# EasyEDA Pro project Jarvis.eprj, schematic Schematic7_1
Board Name: LogicUnit; Create Date: 2026-04-14; Page Name: P1; Project Name: Jarvis; Schematic Name: Schematic7_1; Update Date: 2026-04-14; Company: EasyEDA.com; Page Size: A4; Version: V1.0
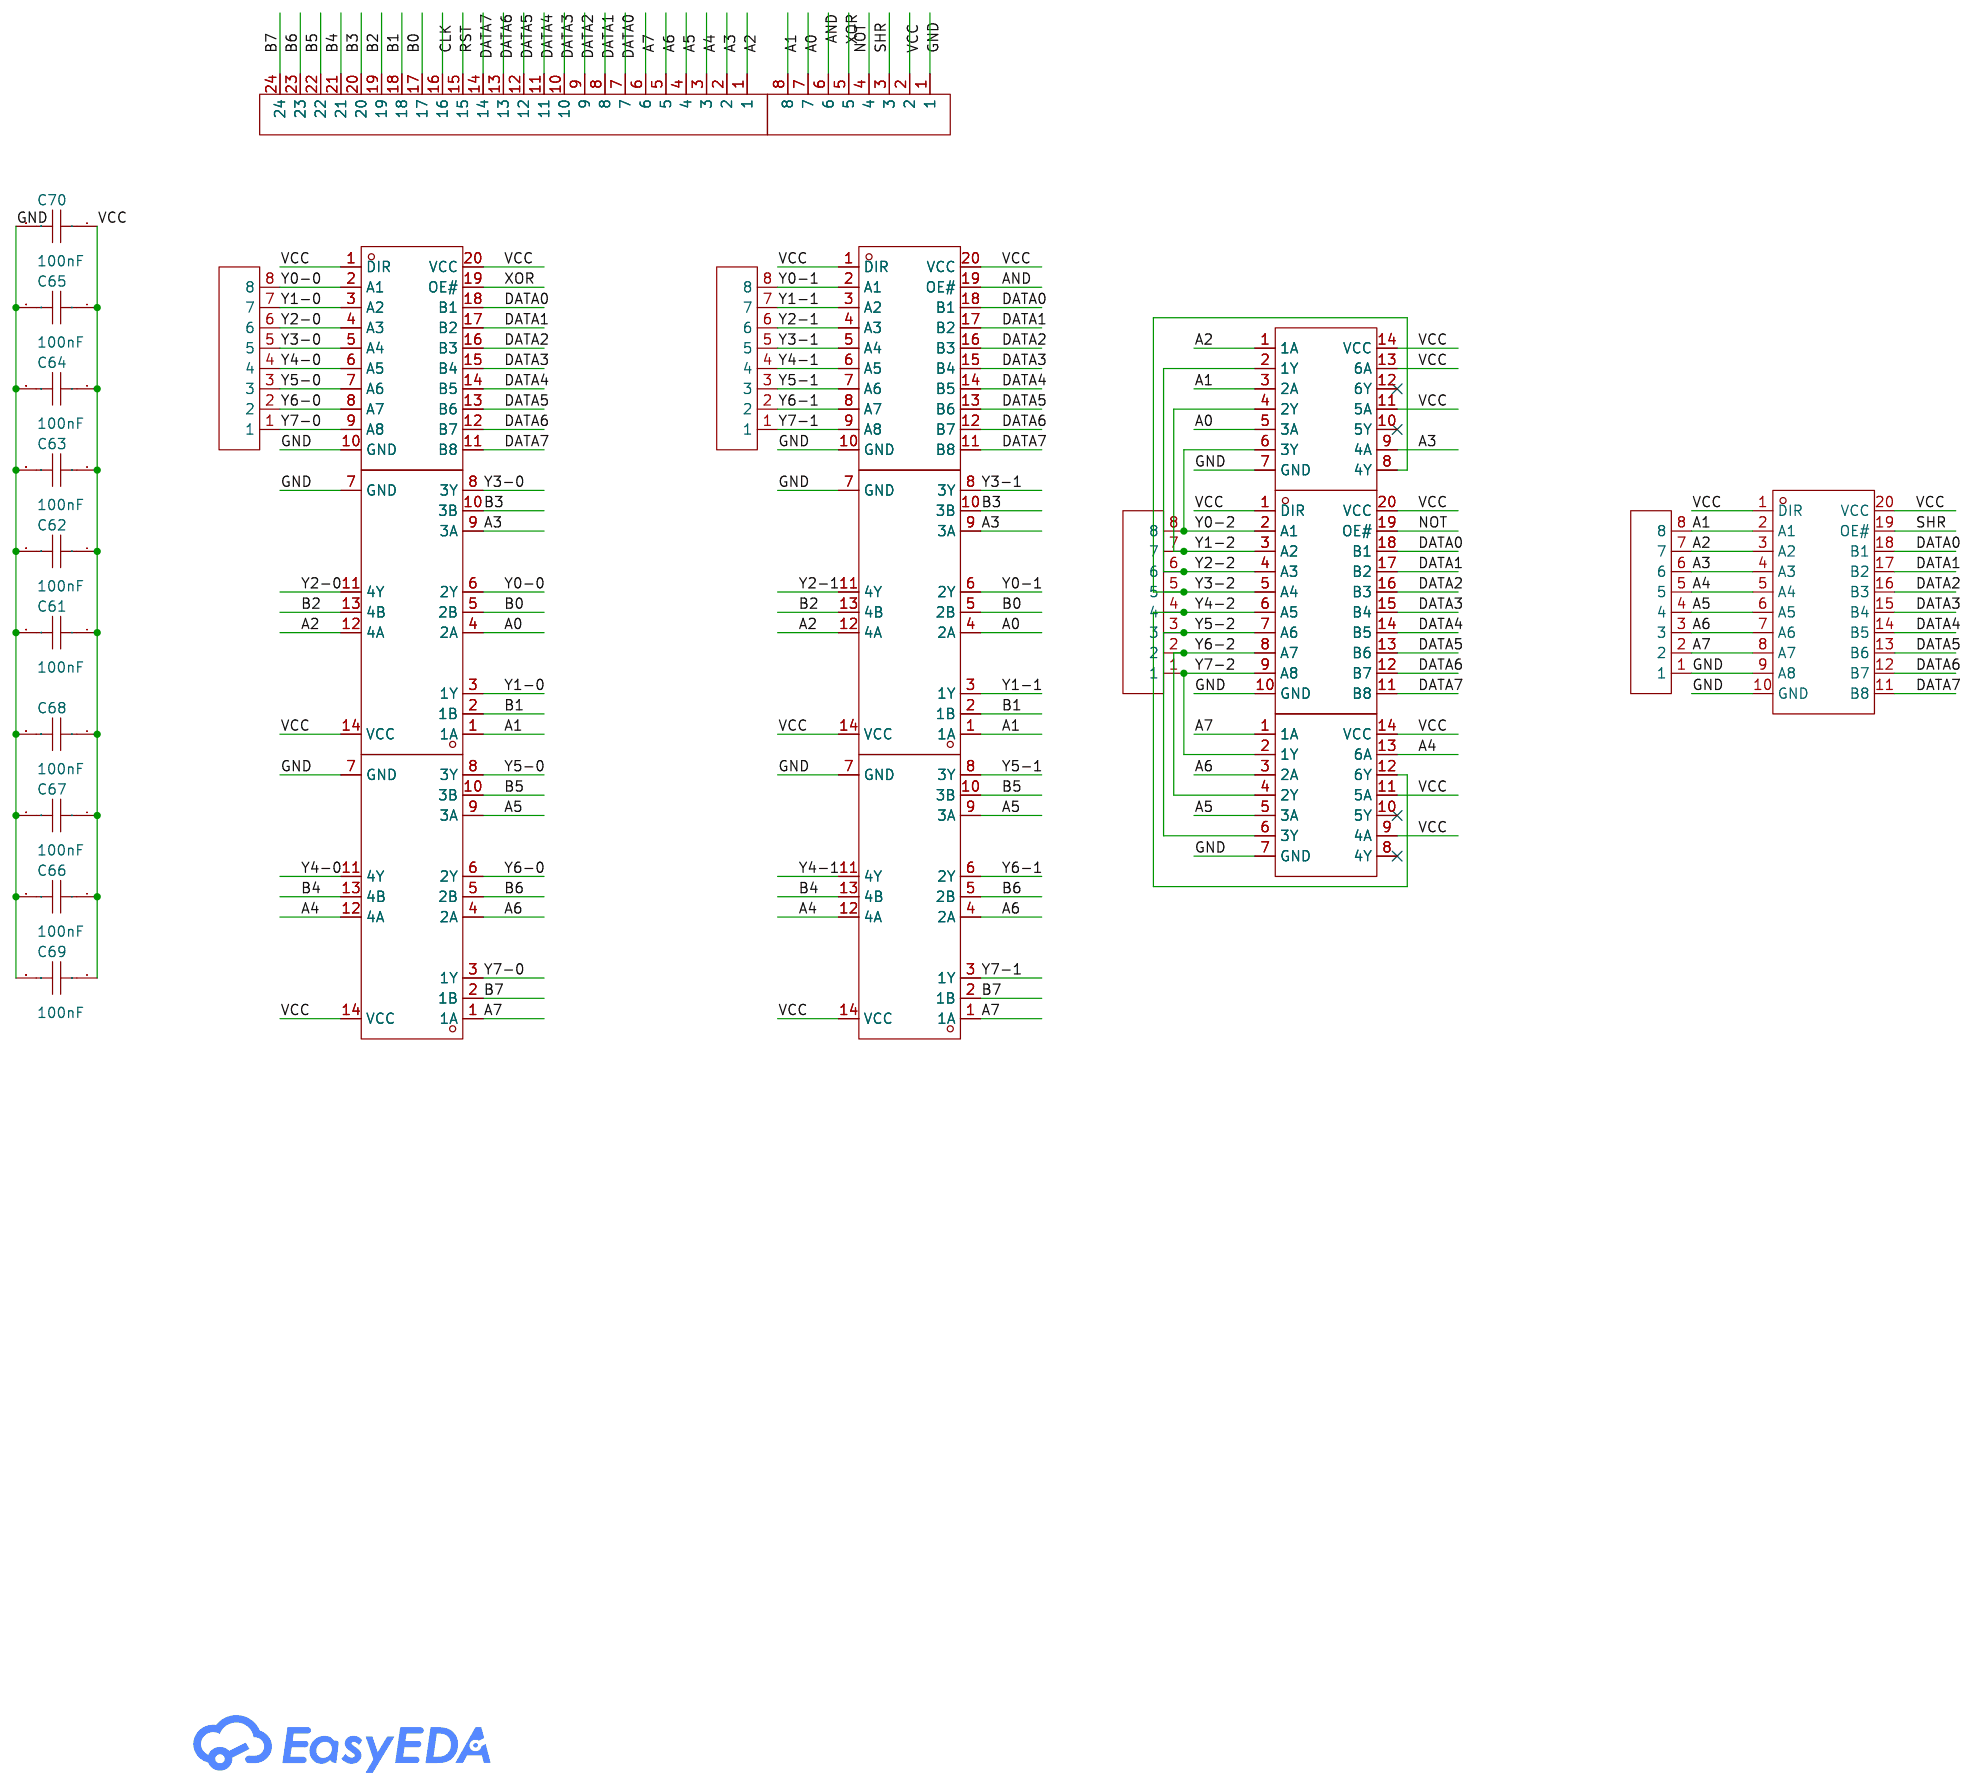
[diagram p5: schematic sheet]

## Parts
C61  100nF  [CAP-TH_L5.0-W2.5-P5.00-D1.0]
C62  100nF  [CAP-TH_L5.0-W2.5-P5.00-D1.0]
C63  100nF  [CAP-TH_L5.0-W2.5-P5.00-D1.0]
C64  100nF  [CAP-TH_L5.0-W2.5-P5.00-D1.0]
C65  100nF  [CAP-TH_L5.0-W2.5-P5.00-D1.0]
C66  100nF  [CAP-TH_L5.0-W2.5-P5.00-D1.0]
C67  100nF  [CAP-TH_L5.0-W2.5-P5.00-D1.0]
C68  100nF  [CAP-TH_L5.0-W2.5-P5.00-D1.0]
C69  100nF  [CAP-TH_L5.0-W2.5-P5.00-D1.0]
C70  100nF  [CAP-TH_L5.0-W2.5-P5.00-D1.0]
U210  SN74HC04N(LX)  [DIP-14_L19.6-W6.4-P2.54-LS7.6-BL]
U237  SN74HC245N3  [PDIP-20_L25.9-W6.6-P2.54-LS7.9-BL]
U316  SN74HC08NE4  [PDIP-14_L19.3-W6.5-P2.54-LS7.6-BL]
U317  SN74HC86N(LX)  [PDIP-14_L19.3-W6.5-P2.54-LS7.6-BL]
U319  SN74HC86N(LX)  [PDIP-14_L19.3-W6.5-P2.54-LS7.6-BL]
U320  SN74HC08NE4  [PDIP-14_L19.3-W6.5-P2.54-LS7.6-BL]
U321  SN74HC04N(LX)  [DIP-14_L19.6-W6.4-P2.54-LS7.6-BL]
U382  TH2.54_8P_0.6  [HDR-TH_8P-P2.54-V-M-3]
U384  TH2.54-24P排针(母)(邮寄专用)  [HDR-TH_24P-P2.54-V-F]
U389  SN74HC245N3  [PDIP-20_L25.9-W6.6-P2.54-LS7.9-BL]
U390  SN74HC245N3  [PDIP-20_L25.9-W6.6-P2.54-LS7.9-BL]
U393  TH2.54_8P_0.6  [HDR-TH_8P-P2.54-V-M-3]
U394  TH2.54_8P_0.6  [HDR-TH_8P-P2.54-V-M-3]
U395  TH2.54_8P_0.6  [HDR-TH_8P-P2.54-V-M-3]
U396  SN74HC245N3  [PDIP-20_L25.9-W6.6-P2.54-LS7.9-BL]
U397  TH2.54_8P_0.6  [HDR-TH_8P-P2.54-V-M-3]

## Library data of the parts
C61-C70 = 178MU0006: LCSC Part Name: 100nF ±10% 50V; Supplier Part: C5632430; Manufacturer: KNSCHA(科尼盛); Supplier Footprint: 插件,P=2.54mm; JLCPCB Part Class: Extended Part; Datasheet: https://item.szlcsc.com/datasheet/178MU0006/6552585.html; Supplier: LCSC; Tolerance: ±10%; Voltage Rating: 50V; Temperature Coefficient: X7R; Pin Spacing: 2.54mm
U210 U321 = SN74HC04N(LX): LCSC Part Name: 集成电路; Supplier Part: C22436641; Manufacturer: LX(灵星芯微); Supplier Footprint: DIP-14; JLCPCB Part Class: Extended Part; Datasheet: https://item.szlcsc.com/datasheet/SN74HC04N(LX)/24070577.html; Supplier: LCSC; Voltage - Supply: 2V~6V; Quiescent Current(Iq): 2uA; Number of Circuits: 6; Input Logic Level - High: 1.5V~4.2V; Input Logic Level -Low: 500mV~1.8V; Output Logic Level - High: 4.4V；5.9V；1.9V; Output Logic Level - Low: 260mV；260mV；100mV; Propagation Delay: 14ns@6V,50pF; Series: 74HC Series; Operating Temperature: -40℃~+125℃
U237 U389 U390 U396 = SN74HC245N3: Supplier Part: C3587488; Manufacturer: TI(德州仪器); Supplier Footprint: PDIP-20; JLCPCB Part Class: Extended Part; Datasheet: https://item.szlcsc.com/datasheet/SN74HC245N3/4154202.html; Supplier: LCSC; output type: Tri-State; Voltage - Supply: 2V~6V; Number of Elements: 1; Number of Bits per Element: 8; Channel Type: Bidirectional; Current - Output Low(IOL): 7.8mA; Current - Output High(IOH): 7.8mA; Logic Family: 74HC; Operating Temperature: -40℃~+85℃; Quiescent Current: 80uA; Propagation Delay: 21ns@4.5V,50pF
U316 U320 = SN74HC08NE4: Supplier Part: C20345708; Manufacturer: TI(德州仪器); Supplier Footprint: PDIP-14; JLCPCB Part Class: Extended Part; Datasheet: https://item.szlcsc.com/datasheet/SN74HC08NE4/21671235.html; Supplier: LCSC; Logic Type: AND Gate; Number of Channels: 4; Voltage - Supply: 2V~6V; Quiescent Current: 20uA; Current - Output Low(IOL): 5.2mA; Current - Output High(IOH): 5.2mA; Input Logic Level - High: 1.5V；4.2V；3.15V; Input Logic Level - Low: 1.35V；500mV；1.8V; Output Logic Level - High: 4.4V；5.9V；1.9V; Output Logic Level - Low: 330mV；260mV；100mV; Series: 74HC; Propagation Delay: 25ns@4.5V,50pF; Operating Temperature: -40℃~+85℃; Input Number: 2
U317 U319 = SN74HC86N(LX): LCSC Part Name: 集成电路; Supplier Part: C22436661; Manufacturer: LX(灵星芯微); Supplier Footprint: DIP-14; JLCPCB Part Class: Extended Part; Datasheet: https://atta.szlcsc.com/upload/public/pdf/source/20240524/675B1C928075FFB7AC00BEC82378813F.pdf; Supplier: LCSC; Logic Type: XOR Gate; Number of Channels: 4; Voltage - Supply: 2V~6V; Quiescent Current: 2uA; Input Logic Level - High: 1.5V~4.2V; Input Logic Level - Low: 500mV~1.8V; Series: 74HCSeries; Operating Temperature: -40℃~+125℃
U382 U393-U395 U397 = TH2.54_8P_0.6: Supplier Part: C9900018349; Supplier Footprint: HDR-TH-8P; JLCPCB Part Class: Extended Part; Supplier: LCSC
U384 = TH2.54-24P排针(母)(邮寄专用): Supplier Part: C9900014057; Supplier Footprint: HDR-TH_24P-P2.54-V-M; JLCPCB Part Class: Extended Part; Supplier: LCSC

## Nets
GND: C61.2 C62.2 C63.2 C64.2 C65.2 C66.2 C67.2 C68.2 C69.2 C70.2 U210.7(GND) U237.10(GND) U316.7(GND) U317.7(GND) U319.7(GND) U320.7(GND) U321.7(GND) U382.1 U389.10(GND) U390.10(GND) U396.9(A8) U396.10(GND) U397.1
VCC: C61.1 C62.1 C63.1 C64.1 C65.1 C66.1 C67.1 C68.1 C69.1 C70.1 U210.11(5A) U210.13(6A) U210.14(VCC) U237.1(DIR) U237.20(VCC) U316.14(VCC) U317.14(VCC) U319.14(VCC) U320.14(VCC) U321.9(4A) U321.11(5A) U321.14(VCC) U382.2 U389.1(DIR) U389.20(VCC) U390.1(DIR) U390.20(VCC) U396.1(DIR) U396.20(VCC)
A0: U210.5(3A) U317.4(2A) U320.4(2A) U382.7
A1: U210.3(2A) U317.1(1A) U320.1(1A) U382.8 U396.2(A1) U397.8
A2: U210.1(1A) U317.12(4A) U320.12(4A) U384.1 U396.3(A2) U397.7
A3: U210.9(4A) U317.9(3A) U320.9(3A) U384.2 U396.4(A3) U397.6
A4: U316.12(4A) U319.12(4A) U321.13(6A) U384.3 U396.5(A4) U397.5
A5: U316.9(3A) U319.9(3A) U321.5(3A) U384.4 U396.6(A5) U397.4
A6: U316.4(2A) U319.4(2A) U321.3(2A) U384.5 U396.7(A6) U397.3
A7: U316.1(1A) U319.1(1A) U321.1(1A) U384.6 U396.8(A7) U397.2
AND: U382.6 U389.19(OE#)
B0: U317.5(2B) U320.5(2B) U384.17
B1: U317.2(1B) U320.2(1B) U384.18
B2: U317.13(4B) U320.13(4B) U384.19
B3: U317.10(3B) U320.10(3B) U384.20
B4: U316.13(4B) U319.13(4B) U384.21
B5: U316.10(3B) U319.10(3B) U384.22
B6: U316.5(2B) U319.5(2B) U384.23
B7: U316.2(1B) U319.2(1B) U384.24
CLK: U384.16
DATA0: U237.18(B1) U384.7 U389.18(B1) U390.18(B1) U396.18(B1)
DATA1: U237.17(B2) U384.8 U389.17(B2) U390.17(B2) U396.17(B2)
DATA2: U237.16(B3) U384.9 U389.16(B3) U390.16(B3) U396.16(B3)
DATA3: U237.15(B4) U384.10 U389.15(B4) U390.15(B4) U396.15(B4)
DATA4: U237.14(B5) U384.11 U389.14(B5) U390.14(B5) U396.14(B5)
DATA5: U237.13(B6) U384.12 U389.13(B6) U390.13(B6) U396.13(B6)
DATA6: U237.12(B7) U384.13 U389.12(B7) U390.12(B7) U396.12(B7)
DATA7: U237.11(B8) U384.14 U389.11(B8) U390.11(B8) U396.11(B8)
NOT: U382.4 U390.19(OE#)
RST: U384.15
SHR: U382.3 U396.19(OE#)
XOR: U237.19(OE#) U382.5
Y0-0: U237.2(A1) U317.6(2Y) U393.8
Y0-1: U320.6(2Y) U389.2(A1) U394.8
Y0-2: U210.6(3Y) U390.2(A1) U395.8
Y1-0: U237.3(A2) U317.3(1Y) U393.7
Y1-1: U320.3(1Y) U389.3(A2) U394.7
Y1-2: U210.4(2Y) U390.3(A2) U395.7
Y2-0: U237.4(A3) U317.11(4Y) U393.6
Y2-1: U320.11(4Y) U389.4(A3) U394.6
Y2-2: U210.2(1Y) U390.4(A3) U395.6
Y3-0: U237.5(A4) U317.8(3Y) U393.5
Y3-1: U320.8(3Y) U389.5(A4) U394.5
Y3-2: U210.8(4Y) U390.5(A4) U395.5
Y4-0: U237.6(A5) U319.11(4Y) U393.4
Y4-1: U316.11(4Y) U389.6(A5) U394.4
Y4-2: U321.12(6Y) U390.6(A5) U395.4
Y5-0: U237.7(A6) U319.8(3Y) U393.3
Y5-1: U316.8(3Y) U389.7(A6) U394.3
Y5-2: U321.6(3Y) U390.7(A6) U395.3
Y6-0: U237.8(A7) U319.6(2Y) U393.2
Y6-1: U316.6(2Y) U389.8(A7) U394.2
Y6-2: U321.4(2Y) U390.8(A7) U395.2
Y7-0: U237.9(A8) U319.3(1Y) U393.1
Y7-1: U316.3(1Y) U389.9(A8) U394.1
Y7-2: U321.2(1Y) U390.9(A8) U395.1

Not connected (* = marked no-connect by the designer): U210 10(5Y)* 12(6Y)*; U321 8(4Y)* 10(5Y)*
